# EasyEDA Pro project Arduino UNO DIY.eprj, board PCB4
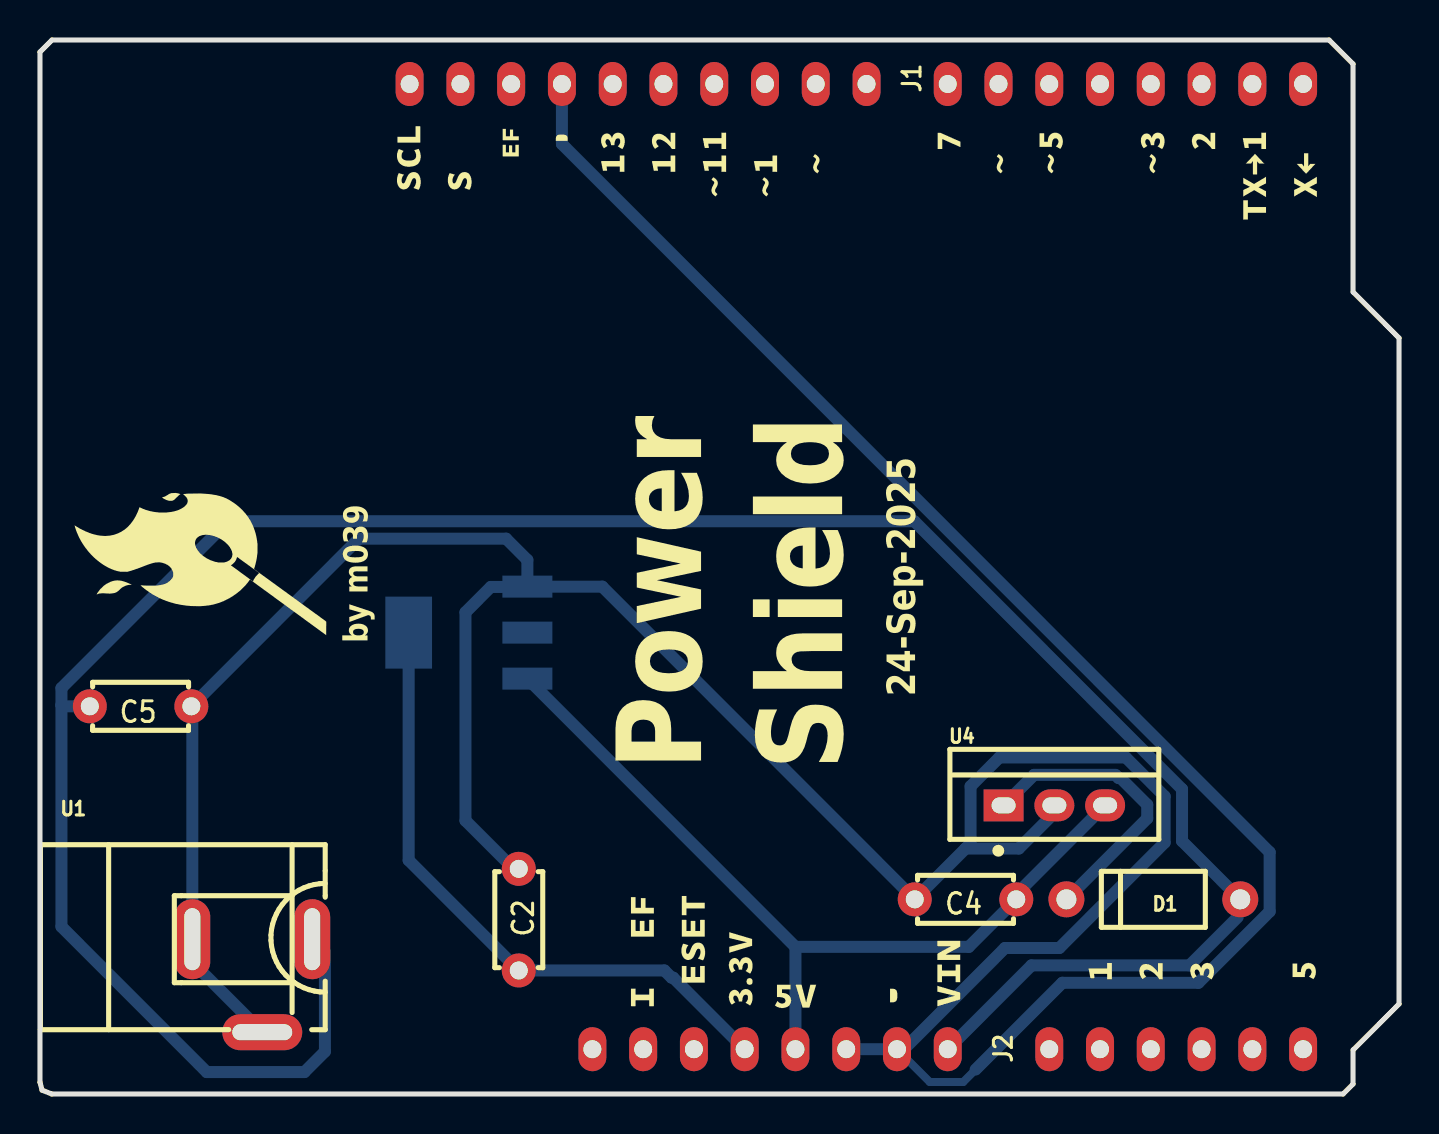
[diagram p16: board, top side]
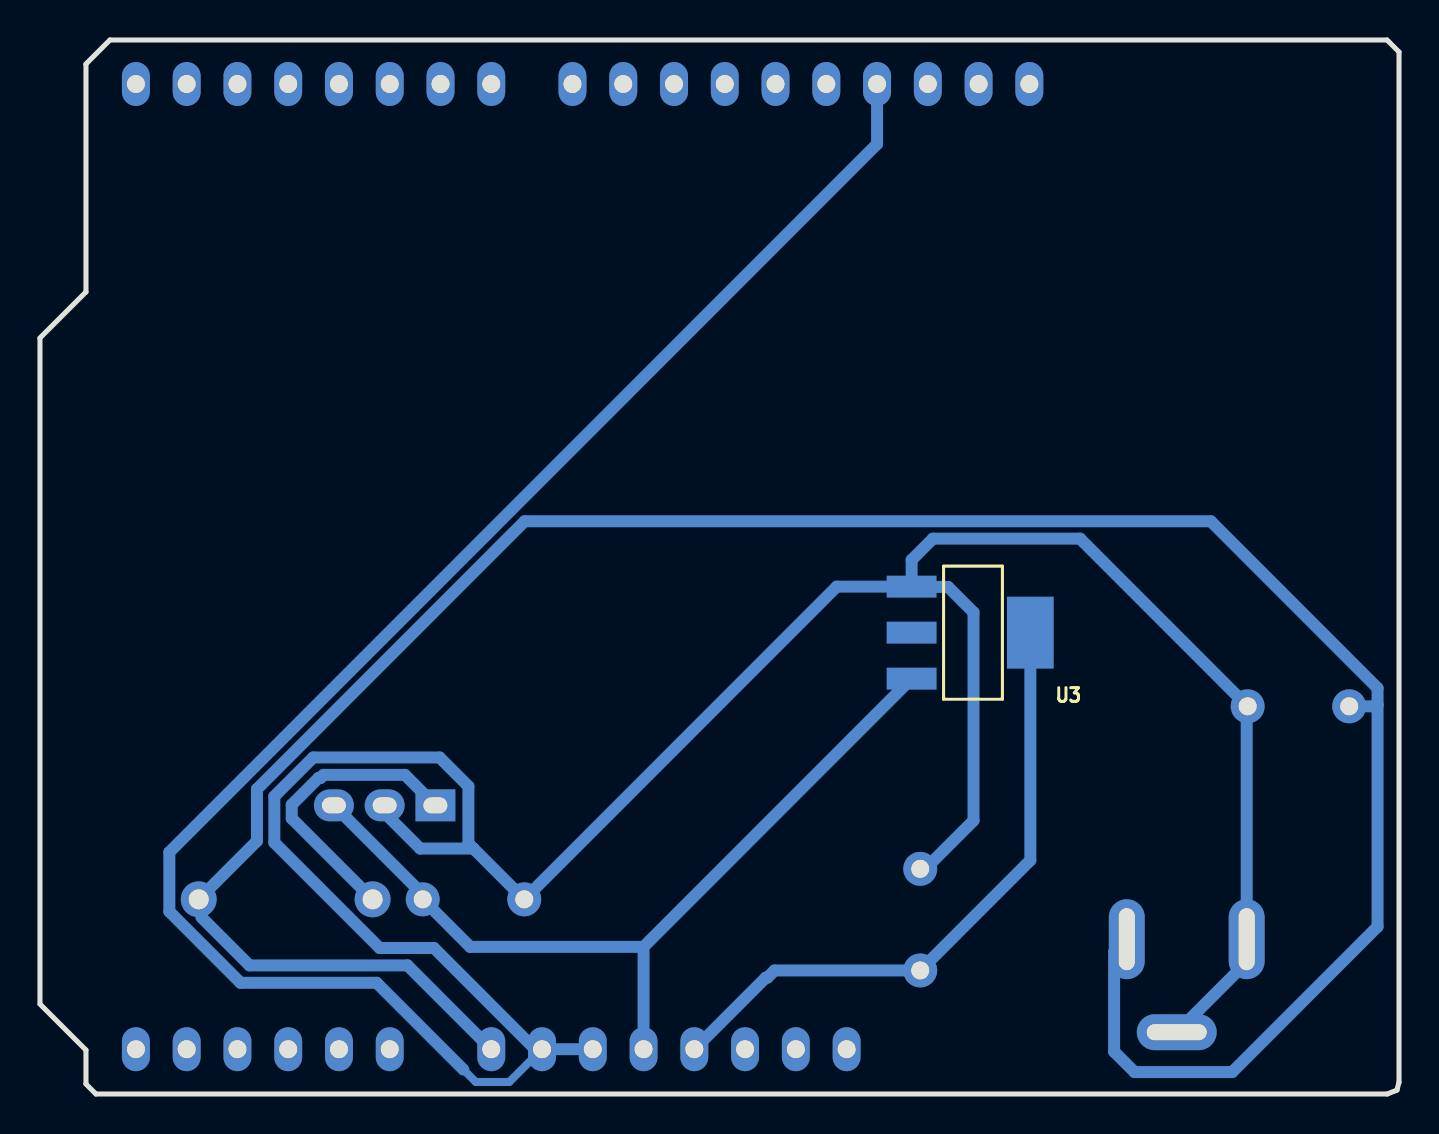
[diagram p17: board, bottom side, seen from below]

Outline 68 x 52.7 mm; copper layers: Top Layer, Bottom Layer. Coordinates in mm from the lower left corner of the outline.
Outline path: 0,52.1 0.6,52.7 64.5,52.7 65.7,51.5 65.7,40.1 68,37.8 68,4.5 65.7,2.2 65.7,0.5 65.2,0 0.59,0 0.1,0.19 0,0.59 0,52.1
Stack: Top Layer 0.035mm / Dielectric1 1.51mm FR4 er 4.5 / Bottom Layer 0.035mm

## Design rules (mm)
template: Custom Config
spacing copperThickness1oz (default): track to track 0.27, other pairs 0.152 to 0.4
spacing copperThickness2oz: track to track 0.203, other pairs 0.152 to 0.3
track width copperThickness1oz (default): min 0.127, default 0.6, max 2.54
track width copperThickness2oz: min 0.203, default 0.4, max 2.54
differential pair differentialPair (default): width min 0.127, default 0.254, max 2.54; gap min 0.152, default 0.152
via viaSize (default): diameter min 0.5, default 0.61, max 10; hole min 0.3, default 0.305, max 6.3

## Placement (name value [footprint] x y rotation side)
C2  10uF  [CAP-TH_L4.8-W2.4-P5.08-D0.6]  23.96 8.72 90 top
C4  10uF  [CAP-TH_L4.8-W2.4-P5.08-D0.6]  46.31 9.73 180 top
C5  10uF  [CAP-TH_L4.8-W2.4-P5.08-D0.6]  5.03 19.39 0 top
D1  1N5819  [DO-41_BD2.4-L4.7-P8.70-D0.9-FD]  55.71 9.73 180 top
J1  -  [Arduino Uno Top Header]  41.36 50.5 0 top
J2  -  [Arduino Uno Bottom Header]  45.55 2.11 0 top
U1  POWER-JACK  [DC-IN-TH_POWER-JACK]  10.62 5.42 0 top
U3  AMS1117-3.3  [SOT-223-3_L6.5-W3.4-P2.30-LS7.0-BR]  21.42 23.07 0 bottom
U4  7805  [TO-220-3_L10.2-W4.5-P2.54-L]  50.75 14.43 0 top

## Footprints (pads in the part's own frame, mm; a bottom-side part is the same pattern mirrored in y, then rotated)
Arduino Uno Bottom Header
  oval 1.4x2.2 hole 0.9: 1(-17.907,0.127) 2(-15.367,0.127) 3(-12.827,0.127) 4(-10.287,0.127) 5(-7.747,0.127) 6(-5.207,0.127) 7(-2.667,0.127) 8(-0.127,0.127) 9(4.953,0.127) 10(7.493,0.127) 11(10.033,0.127) 12(12.573,0.127) 13(15.113,0.127) 14(17.653,0.127)
Arduino Uno Top Header
  oval 1.4x2.2 hole 0.9: 1(21.844,0) 2(19.304,0) 3(16.764,0) 4(14.224,0) 5(11.684,0) 6(9.144,0) 7(6.604,0) 8(4.064,0) 9(0,0) 10(-2.54,0) 11(-5.08,0) 12(-7.62,0) 13(-10.16,0) 14(-12.7,0) 15(-15.24,0) 16(-17.78,0) 17(-20.32,0) 18(-22.86,0)
CAP-TH_L4.8-W2.4-P5.08-D0.6
  round 1.7 hole 0.9: 1(-2.54,0) 2(2.54,0)
DC-IN-TH_POWER-JACK
  oval 1.8x4 hole 0.8x3.1: 1(2.999,2.325) 2(-2.999,2.325)
  oval 4x1.8 hole 3x0.8: 3(0.5,-2.325)
DO-41_BD2.4-L4.7-P8.70-D0.9-FD
  round 1.8 hole 1x0.9: 1(-4.35,0) 2(4.35,0)
SOT-223-3_L6.5-W3.4-P2.30-LS7.0-BR
  rect 2.5x1.1 smd: 1(2.97,-2.3) 2(2.97,0) 3(2.97,2.3)
  rect 2.34x3.6 smd: 4(-2.97,0)
TO-220-3_L10.2-W4.5-P2.54-L
  rect 2x1.6 hole 1.2x0.8: 1(-2.54,0)
  oval 2x1.6 hole 1.2x0.8: 2(0,0) 3(2.54,0)

## Nets
As in the schematic.

Pads without a net: J1 1 2 3 4 5 6 7 8 9 10 11 12 13 14 16 17 18; J2 1 2 3 9 10 11 12 13 14; U3 2

## Routing (per net, layer and track width the routed paths; a pad name or vN(x,y) marks a point on that pad's centre or on a via; arc(x,y) is an arc through that point)
+3.3V: length 32.1
  Bottom Layer w0.6: U3.4 18.45,11.69 C2.1 31.24,6.18 31.6,5.82 31.68,5.82 J2.4
+5V: length 42.7
  Bottom Layer w0.6: U4.3 48.85,9.99 48.85,9.73 46.47,7.36 37.8,7.36 ; U3.3 37.8,7.36 ; 37.8,7.36 J2.5
GND: length 208.3
  Bottom Layer w0.4: J2.7 44.52,0.6 46.19,0.6 46.82,1.22
  Bottom Layer w0.6: J1.15 26.12,47.5 61.53,12.09 61.53,9.12 57.96,5.56 51.15,5.56 46.82,1.22 ; 46.31,12.27 C4.2 28.13,25.37 U3.1 ; 46.31,12.27 48.98,12.27 50.75,14.05 U4.2 ; 46.31,12.27 46.56,12.53 46.56,15.39 48,16.83 54.33,16.83 56.27,14.88 56.27,12.57 51,7.3 48.28,7.3 43.22,2.24 J2.7 J2.6 ; C2.2 23.7,11.26 21.29,13.67 21.29,24.08 22.56,25.35 24.37,25.35 U3.1 ; U3.1 24.39,26.7 23.32,27.77 15.96,27.77 C5.2 7.62,19.34 U1.2 7.62,6.59 U1.3
VIN: length 124.9
  Bottom Layer w0.6: J2.8 49.61,6.43 57.52,6.43 59.93,8.84 ; 60.06,9.73 57.14,12.65 57.14,15.24 43.75,28.64 9.42,28.64 1.07,20.29 1.07,19.45 ; 1.07,19.45 1.13,19.39 C5.1 ; 1.07,19.45 1.07,8.37 8.34,1.1 13.23,1.1 14.26,2.12 14.26,7.11 U1.1
$1N4261: length 14.8
  Bottom Layer w0.6: D1.2 55.4,13.78 55.4,14.46 54.06,15.8 53.96,15.8 53.81,15.96 49.74,15.96 U4.1

## Text on the board
Top Silkscreen Layer: by m039 | 24-Sep-2025 | Power / Shield
